# EasyEDA Pro project STM32G303的双FOC电机驱动.eprj, schematic axdr_v1.3, sheets 1 to 2 of 4

## Sheets
1 mcu: Board Name: 1.axdr_v1.3; Create Date: 2025-06-19; Page Name: mcu; Project Name: STM32G303的双FOC电机驱动; Schematic Name: axdr_v1.3; Update Date: 2025-07-27; Company: 嘉立创EDA
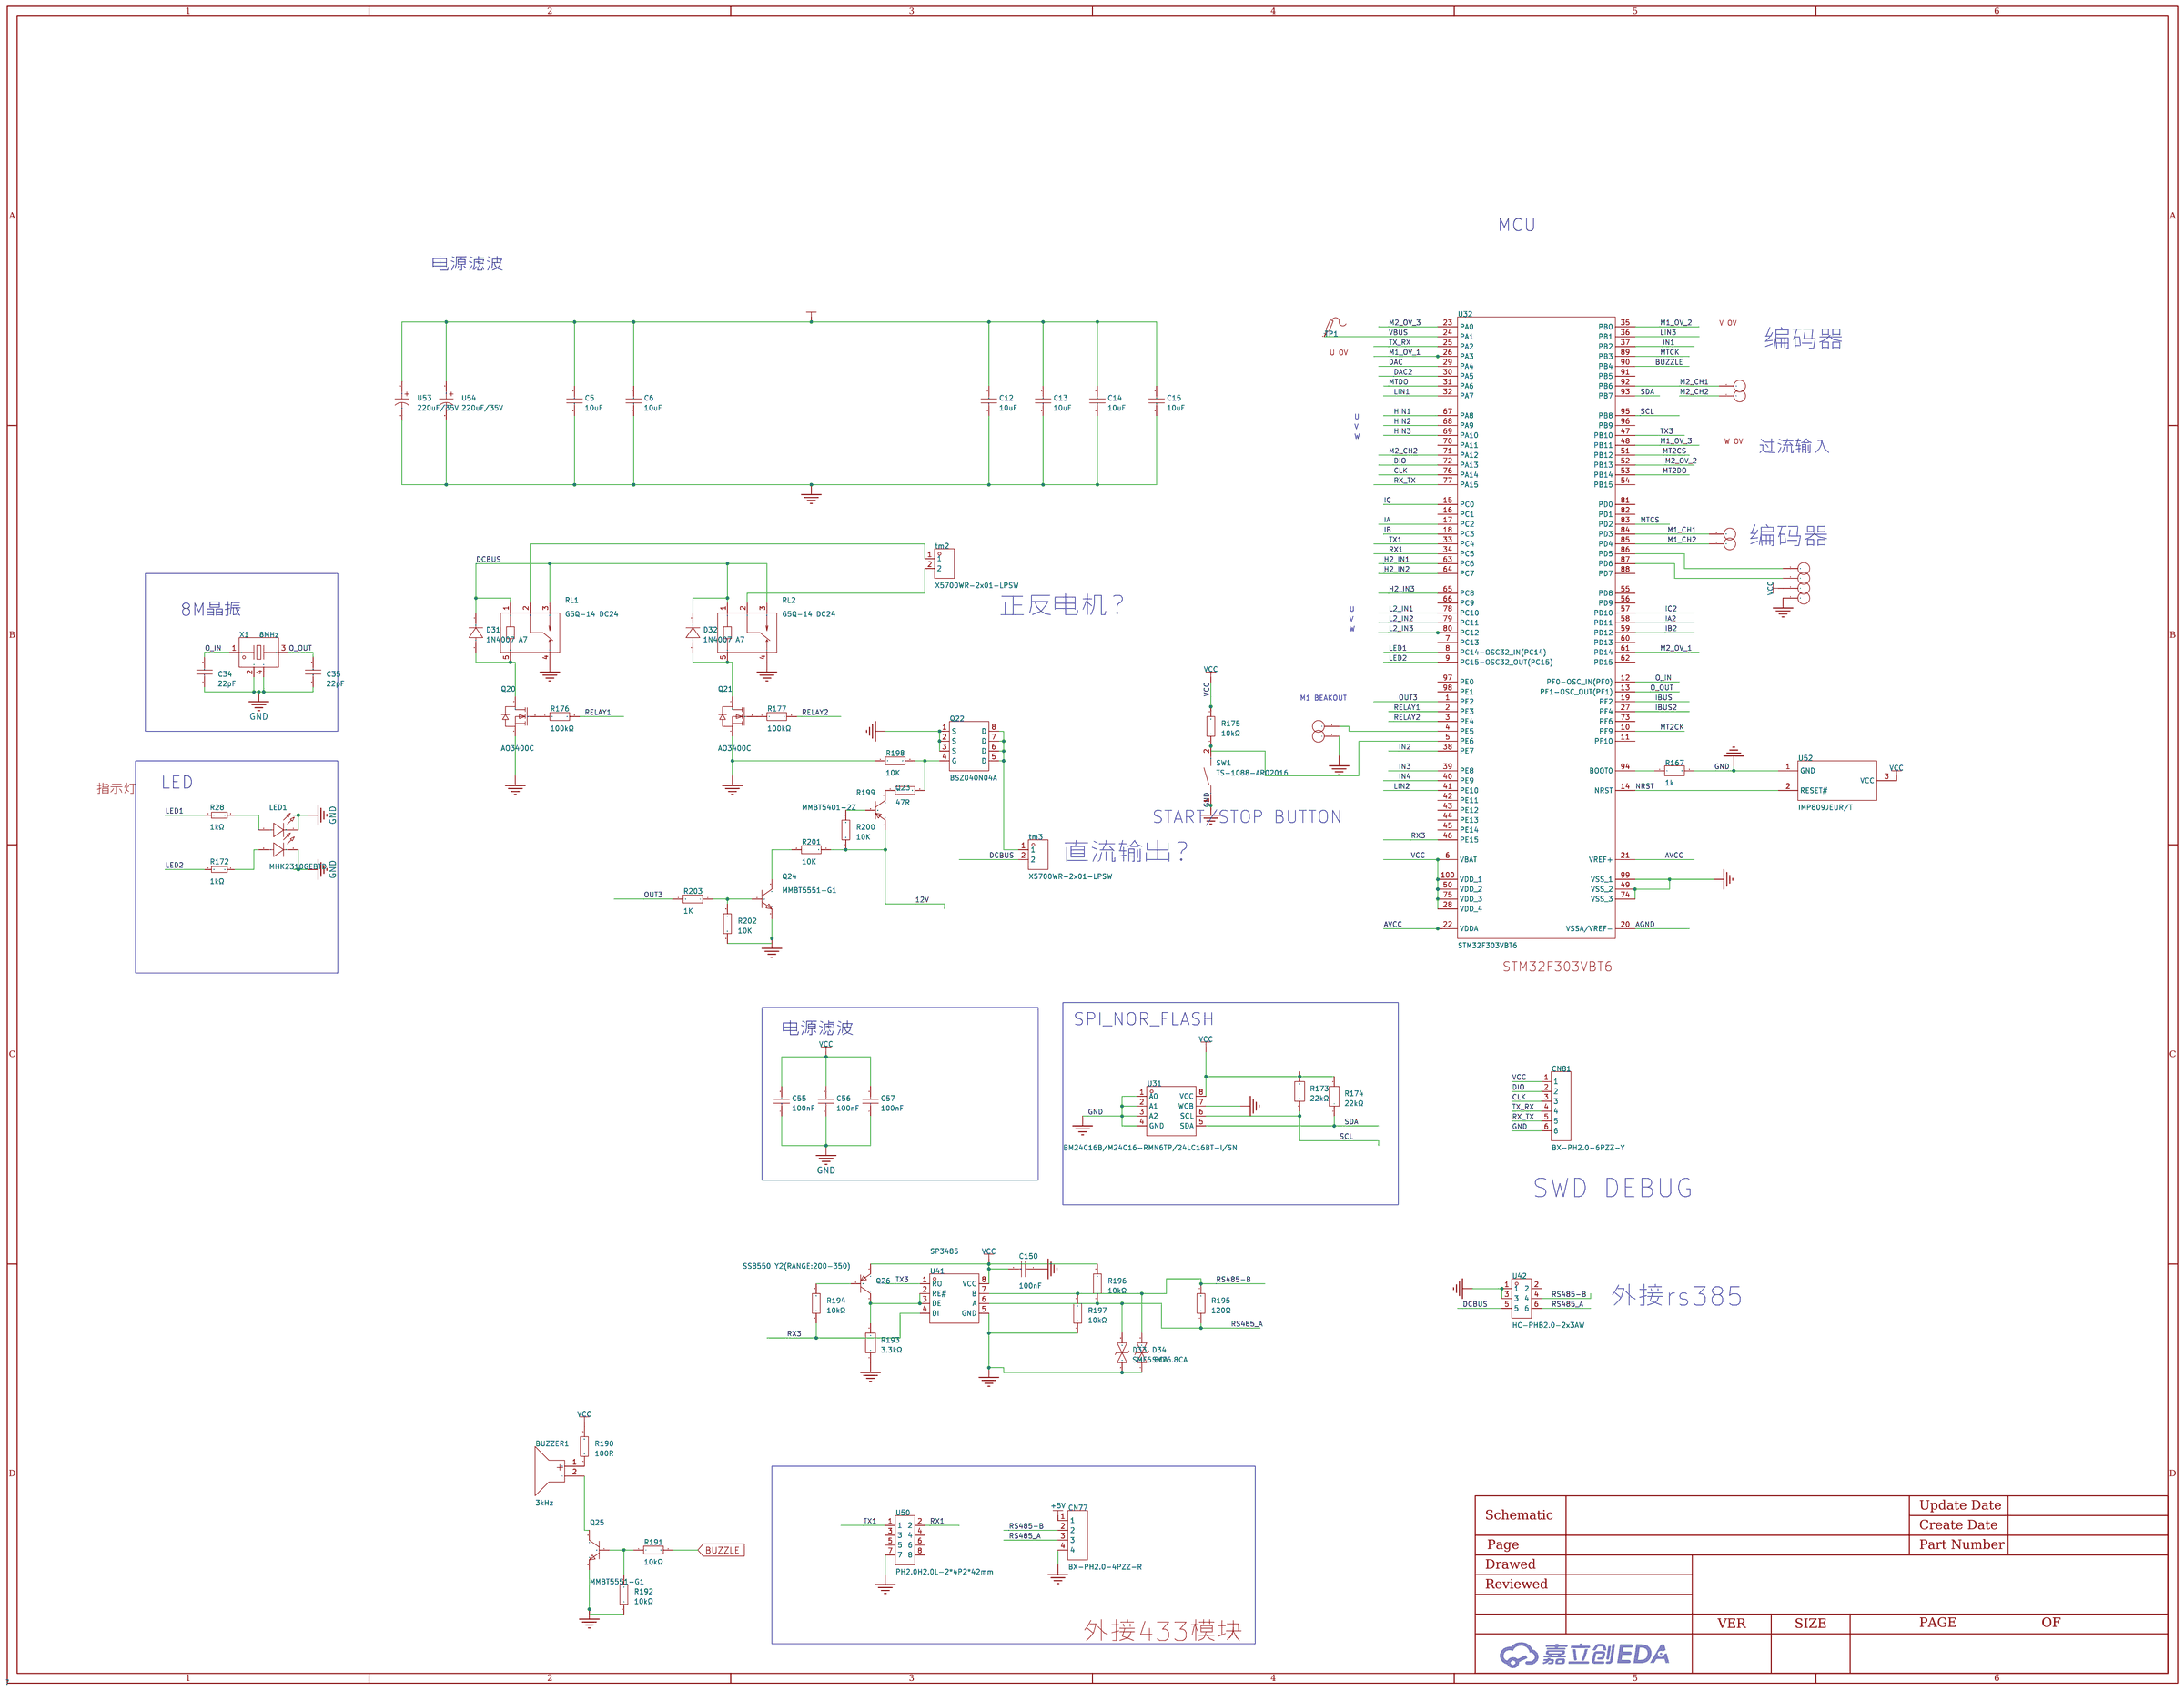
[diagram p1: mcu]
2 电机驱动: Page Name: 电机驱动; Update Date: 2025-07-23; Page Size: A4; Version: V1.0
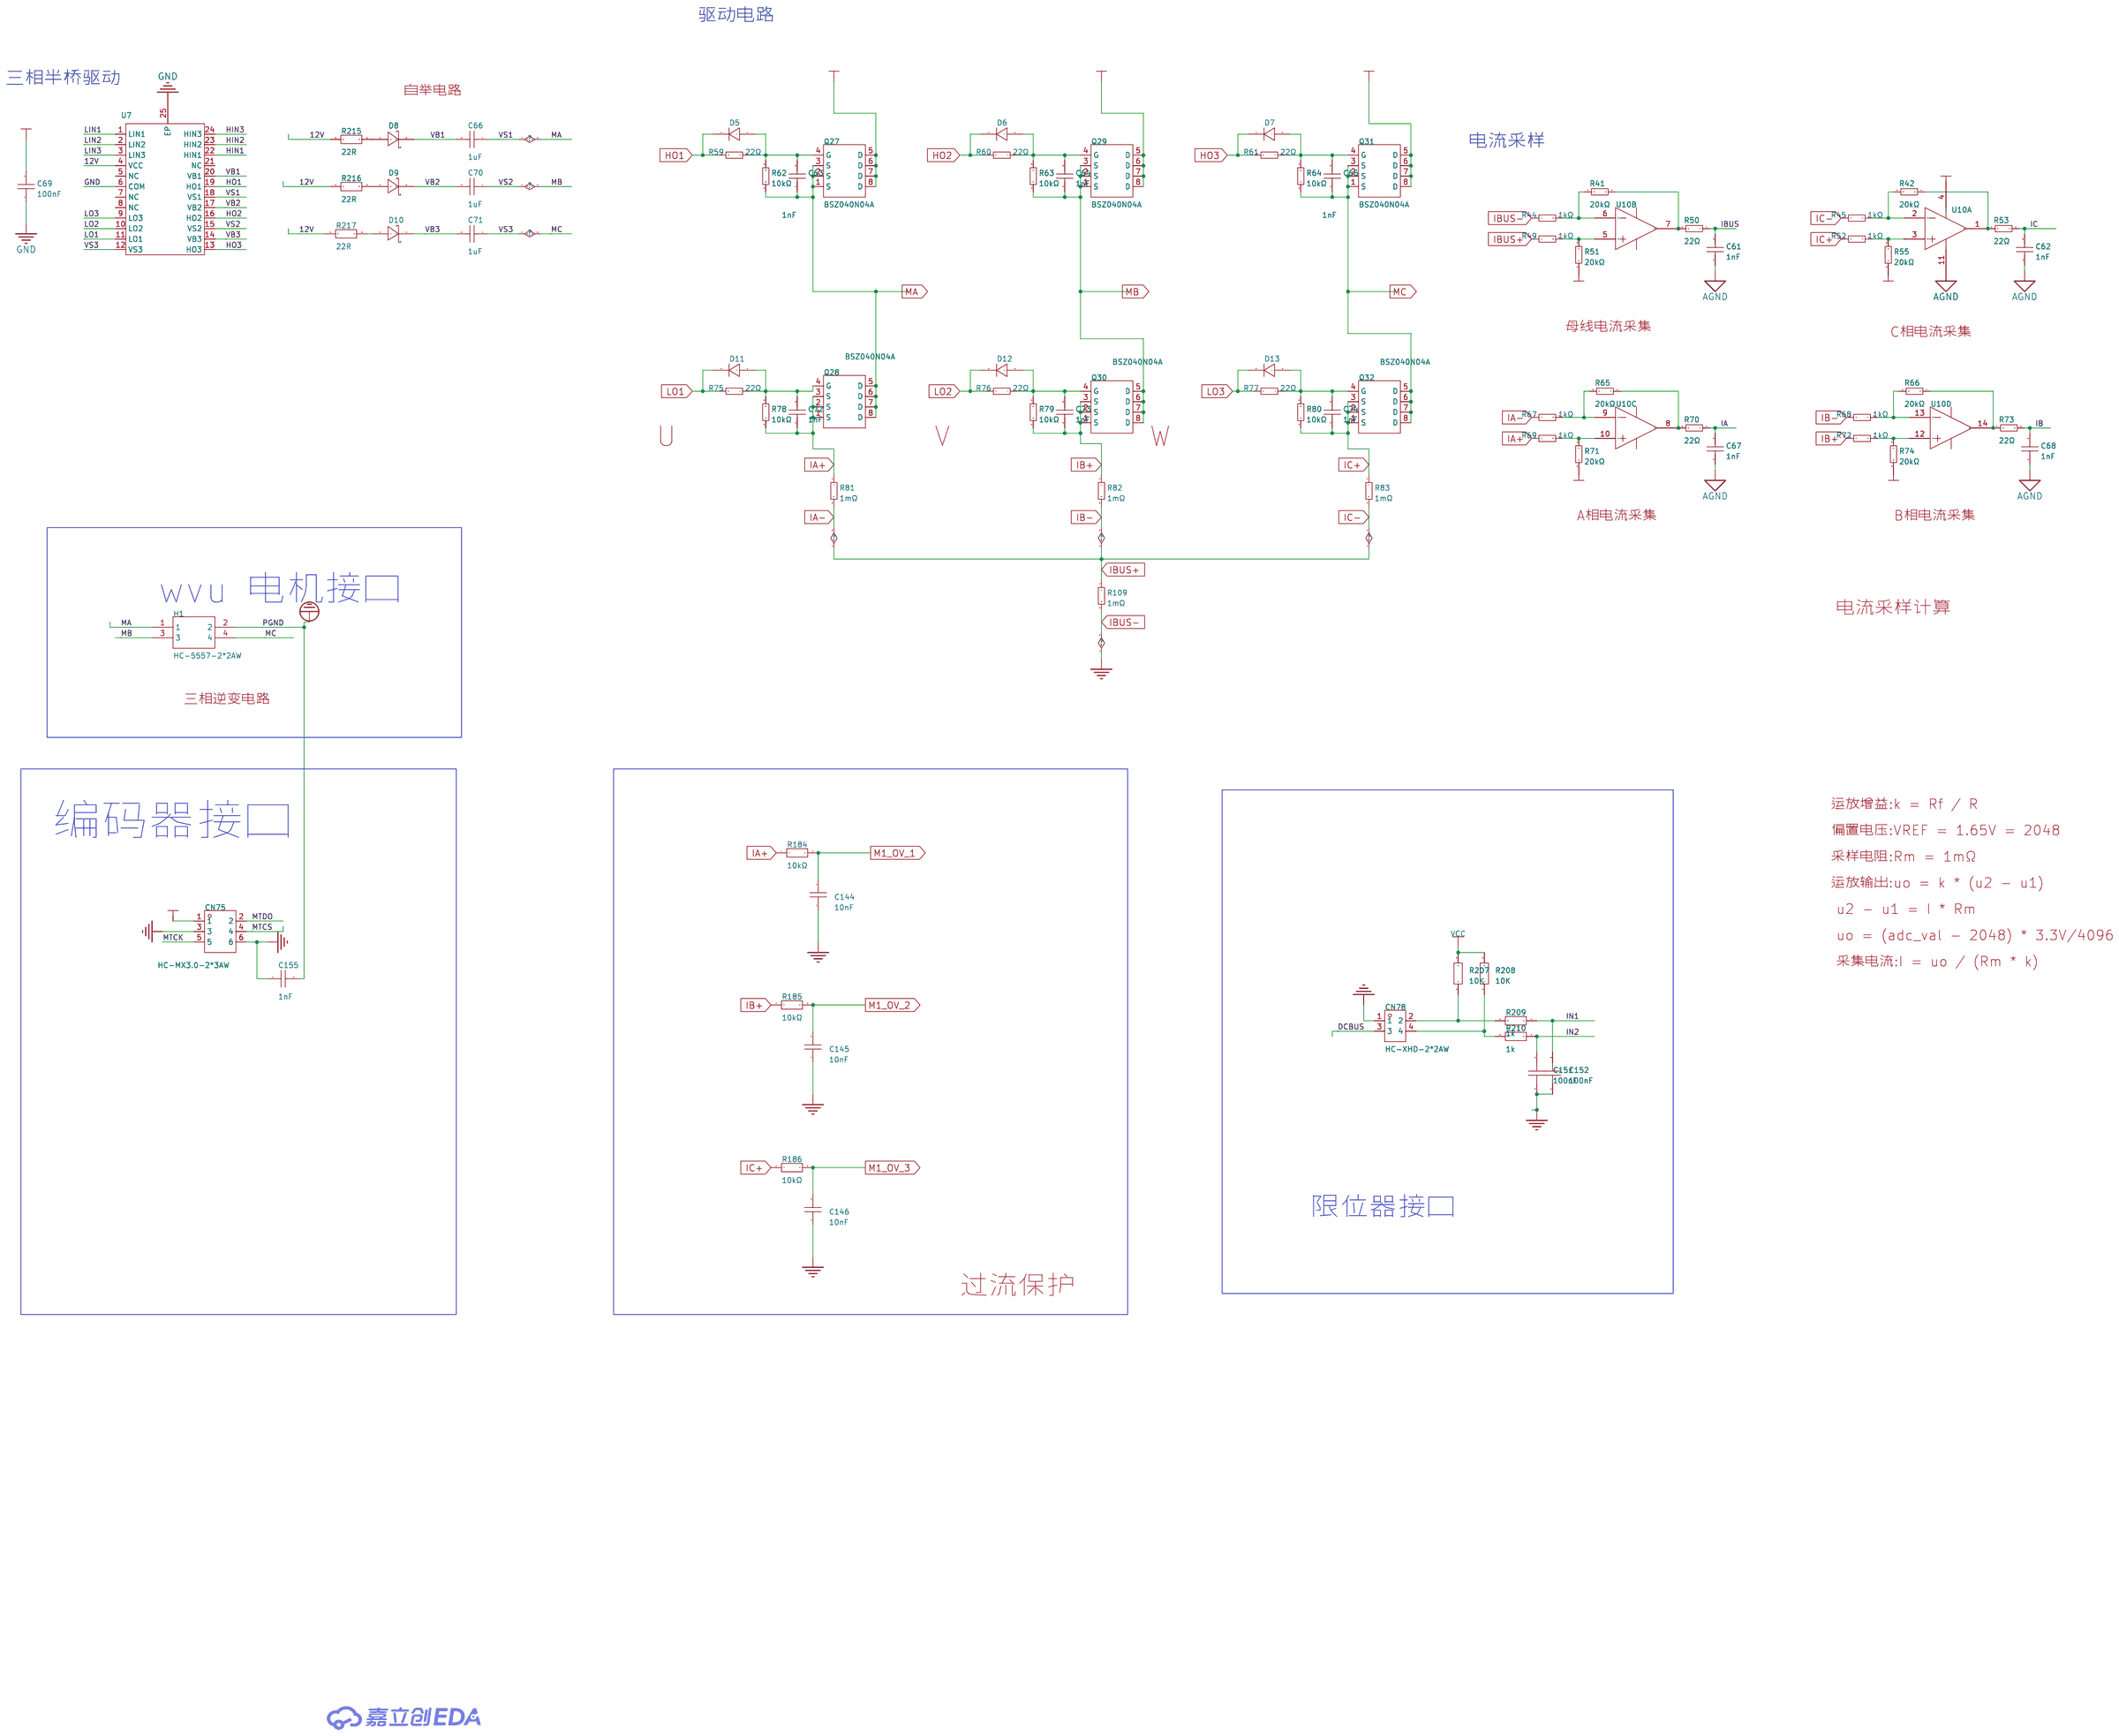
[diagram p2: 电机驱动]

## Parts
sheet mcu
BUZZER1  3kHz  [BUZ-TH_BD9.0-P5.00-D0.6-FD]
C5  10uF  [C1206_S]
C6  10uF  [C1206_S]
C12  10uF  [C1206_S]
C13  10uF  [C1206_S]
C14  10uF  [C1206_S]
C15  10uF  [C1206_S]
C34  22pF  [C0603_S]
C35  22pF  [C0603_S]
C55  100nF  [C0603_S]
C56  100nF  [C0603_S]
C57  100nF  [C0603_S]
C150  100nF  [C0603_S]
CN77  BX-PH2.0-4PZZ-R  [CONN-TH_BX-PH2.0-4PZZ-R]
CN81  BX-PH2.0-6PZZ-Y  [CONN-TH_6P-P2.00_BX-PH2.0-6PZZ-Y]
CN82  5012  [TESTPOINT-TH_BD2.0_C9900010656]  (no BOM)
CN83  5012  [TESTPOINT-TH_BD2.0_C9900010656]  (no BOM)
CN84  5012  [TESTPOINT-TH_BD2.0_C9900010656]  (no BOM)
CN85  5012  [TESTPOINT-TH_BD2.0_C9900010656]  (no BOM)
CN86  5012  [TESTPOINT-TH_BD2.0_C9900010656]  (no BOM)
CN87  5012  [TESTPOINT-TH_BD2.0_C9900010656]  (no BOM)
CN88  5012  [TESTPOINT-TH_BD2.0_C9900010656]  (no BOM)
CN89  5012  [TESTPOINT-TH_BD2.0_C9900010656]  (no BOM)
CN90  5012  [TESTPOINT-TH_BD2.0_C9900010656]  (no BOM)
CN91  5012  [TESTPOINT-TH_BD2.0_C9900010656]  (no BOM)
D31  1N4007 A7  [SOD-123FL_L2.8-W1.8-LS3.7-RD]
D32  1N4007 A7  [SOD-123FL_L2.8-W1.8-LS3.7-RD]
D33  SMF6.8CA  [SOD-123FL_L2.8-W1.8-LS3.7-BI]
D34  SMF6.8CA  [SOD-123FL_L2.8-W1.8-LS3.7-BI]
LED1  MHK2310GEBTD  [LED-TH_4P-L12.8-W4.4_C9900044135]
Q20  AO3400C  [SOT-23-3_L2.9-W1.3-P1.90-LS2.4-BR]
Q21  AO3400C  [SOT-23-3_L2.9-W1.3-P1.90-LS2.4-BR]
Q22  BSZ040N04A  [POWERPAK-1212-8_L3.1-W3.1-P0.65-LS3.3-BL]
Q23  MMBT5401-2Z  [SOT-23-3_L2.9-W1.4-P1.90-LS2.4-TR]
Q24  MMBT5551-G1  [SOT-23-3_L2.9-W1.3-P1.90-LS2.4-BR]
Q25  MMBT5551-G1  [SOT-23-3_L2.9-W1.3-P1.90-LS2.4-BR]
Q26  SS8550 Y2(RANGE:200-350)  [SOT-23-3_L2.9-W1.3-P1.90-LS2.4-BR]
R28  1kΩ  [R0603_S]
R167  1k  [R0603]
R172  1kΩ  [R0603_S]
R173  22kΩ  [R0603]
R174  22kΩ  [R0603]
R175  10kΩ  [R0603]
R176  100kΩ  [R0603]
R177  100kΩ  [R0603]
R190  100R  [R0603]
R191  10kΩ  [R0603]
R192  10kΩ  [R0603]
R193  3.3kΩ  [R0603]
R194  10kΩ  [R0603]
R195  120Ω  [R0603]
R196  10kΩ  [R0603]
R197  10kΩ  [R0603]
R198  10K  [R0603]
R199  47R  [R0603]
R200  10K  [R0603]
R201  10K  [R0603]
R202  10K  [R0603]
R203  1K  [R0603]
RL1  G5Q-14 DC24  [RELAY-TH_G5Q-14-DCXX]
RL2  G5Q-14 DC24  [RELAY-TH_G5Q-14-DCXX]
SW1  TS-1088-AR02016  [SW-SMD_L3.9-W3.0-P4.45]
tm2  X5700WR-2x01-LPSW  [CONN-TH_2P-P5.70_XKB_X5700WR-2X01-LPSW]
tm3  X5700WR-2x01-LPSW  [CONN-TH_2P-P5.70_XKB_X5700WR-2X01-LPSW]
TP1  -  [Test-Point-0.5mm]
U31  BM24C16B/M24C16-RMN6TP/24LC16BT-I/SN  [SOIC-8_L4.9-W3.9-P1.27-LS6.0-BL]
U32  STM32F303VBT6  [LQFP-100_L14.0-W14.0-P0.50-LS16.0-BL]
U41  SP3485  [SOP-8_L4.9-W3.9-P1.27-LS6.0-BL]
U42  HC-PHB2.0-2x3AW  [CONN-TH_6P-P2.00_HC-PHB2.0-2X3AW]
U50  PH2.0H2.0L-2*4P2*42mm  [HDR-TH_8P-P2.00-V-M-R2-C4-S2.00]
U52  IMP809JEUR/T  [SOT-23-3_L2.9-W1.3-P1.90-LS2.4-BR]
U53  220uF/35V  [CAP-TH_BD8.0-P3.50-D0.6-FD_1]
U54  220uF/35V  [CAP-TH_BD8.0-P3.50-D0.6-FD_1]
X1  8MHz  [CRYSTAL-SMD_4P-L3.2-W2.5-BL]
sheet 电机驱动
C61  1nF  [C0603_S]
C62  1nF  [C0603_S]
C63  1nF  [C0603_S]
C64  1nF  [C0603_S]
C65  1nF  [C0603_S]
C66  1uF  [C0603_S]
C67  1nF  [C0603_S]
C68  1nF  [C0603_S]
C69  100nF  [C0603_S]
C70  1uF  [C0603_S]
C71  1uF  [C0603_S]
C72  1nF  [C0603_S]
C73  1nF  [C0603_S]
C74  1nF  [C0603_S]
C144  10nF  [C0603]
C145  10nF  [C0603]
C146  10nF  [C0603]
C151  100nF  [C0603]
C152  100nF  [C0603]
C155  1nF  [C1206]
CN75  HC-MX3.0-2*3AW  [CONN-TH_6P-P3.00_HC-MX3.0-2X3AW_1]
CN78  HC-XHD-2*2AW  [CONN-TH_4P-P2.50_HCTL_HC-XHD-2X2AW]
D5  B16WS  [SOD-323_L1.8-W1.3-LS2.5-RD]
D6  B16WS  [SOD-323_L1.8-W1.3-LS2.5-RD]
D7  B16WS  [SOD-323_L1.8-W1.3-LS2.5-RD]
D8  B16WS  [SOD-323_L1.8-W1.3-LS2.5-RD]
D9  B16WS  [SOD-323_L1.8-W1.3-LS2.5-RD]
D10  B16WS  [SOD-323_L1.8-W1.3-LS2.5-RD]
D11  B16WS  [SOD-323_L1.8-W1.3-LS2.5-RD]
D12  B16WS  [SOD-323_L1.8-W1.3-LS2.5-RD]
D13  B16WS  [SOD-323_L1.8-W1.3-LS2.5-RD]
H1  HC-5557-2*2AW  [CONN-TH_4P-P4.20_5557-2X2AW]
Q27  BSZ040N04A  [POWERPAK-1212-8_L3.1-W3.1-P0.65-LS3.3-BL]
Q28  BSZ040N04A  [POWERPAK-1212-8_L3.1-W3.1-P0.65-LS3.3-BL]
Q29  BSZ040N04A  [POWERPAK-1212-8_L3.1-W3.1-P0.65-LS3.3-BL]
Q30  BSZ040N04A  [POWERPAK-1212-8_L3.1-W3.1-P0.65-LS3.3-BL]
Q31  BSZ040N04A  [POWERPAK-1212-8_L3.1-W3.1-P0.65-LS3.3-BL]
Q32  BSZ040N04A  [POWERPAK-1212-8_L3.1-W3.1-P0.65-LS3.3-BL]
R41  20kΩ  [R0603_S]
R42  20kΩ  [R0603_S]
R44  1kΩ  [R0603_S]
R45  1kΩ  [R0603_S]
R49  1kΩ  [R0603_S]
R50  22Ω  [R0603_S]
R51  20kΩ  [R0603_S]
R52  1kΩ  [R0603_S]
R53  22Ω  [R0603_S]
R55  20kΩ  [R0603_S]
R59  22Ω  [R0603_S]
R60  22Ω  [R0603_S]
R61  22Ω  [R0603_S]
R62  10kΩ  [R0603_S]
R63  10kΩ  [R0603_S]
R64  10kΩ  [R0603_S]
R65  20kΩ  [R0603_S]
R66  20kΩ  [R0603_S]
R67  1kΩ  [R0603_S]
R68  1kΩ  [R0603_S]
R69  1kΩ  [R0603_S]
R70  22Ω  [R0603_S]
R71  20kΩ  [R0603_S]
R72  1kΩ  [R0603_S]
R73  22Ω  [R0603_S]
R74  20kΩ  [R0603_S]
R75  22Ω  [R0603_S]
R76  22Ω  [R0603_S]
R77  22Ω  [R0603_S]
R78  10kΩ  [R0603_S]
R79  10kΩ  [R0603_S]
R80  10kΩ  [R0603_S]
R81  1mΩ  [R2512_S]
R82  1mΩ  [R2512_S]
R83  1mΩ  [R2512_S]
R109  1mΩ  [R2512_S]
R184  10kΩ  [R0603]
R185  10kΩ  [R0603]
R186  10kΩ  [R0603]
R207  10K  [R0603]
R208  10K  [R0603]
R209  1k  [R0603]
R210  1k  [R0603]
R215  22R  [R0603]
R216  22R  [R0603]
R217  22R  [R0603]
U7  FD6288Q  [QFN-24_L4.0-W4.0-P0.50-BL-EP2.6]
U10  RS624XQ  [TSSOP-14_L5.0-W4.4-P0.65-LS6.4-BL]  (sections 1,2,3,4)

## Library data of the parts
BUZZER1 = HNB09A03: 驱动方式:有源(内含驱动线路);构造类型:电磁式;频率:3kHz;声压(SPL):85dB;; LCSC Part Name: 电磁式有源一体蜂鸣器HNB09A03; Supplier Part: C96102; Manufacturer: 华能; Supplier Footprint: 插件,D=9mm; JLCPCB Part Class: 扩展库; Datasheet: https://atta.szlcsc.com/upload/public/pdf/source/20241128/61C4C8C3938BB25F7C38FBE94CCE8DCF.pdf; Supplier: LCSC; Driver Circuitry: 有源(内含驱动线路); Technology: 电磁式; Voltage - Supply: 1.5V~4.5V; Current Consumption: 30mA; Sound Pressure Level(SPL): 85dB; Diameter(φD): 9mm; Height: 5.5mm; Operating Temperature: -20℃~+70℃
C5 C6 C12-C15 = CL31A106KBHNNNE: 容值:10uF;精度:±10%;额定电压:50V;材质(温度系数):X5R;; LCSC Part Name: 10uF ±10% 50V; Supplier Part: C13585; Manufacturer: SAMSUNG(三星); Supplier Footprint: 1206; JLCPCB Part Class: Basic Part; Datasheet: https://atta.szlcsc.com/upload/public/pdf/source/20160218/1457707763339.pdf; Supplier: LCSC; Tolerance: ±10%; Voltage Rated: 50V; Temperature Coefficient: X5R; Pin Type: IN; 值: 10UF; Check: true
C34 C35 = 0603CG220J500NT: 容值:22pF;精度:±5%;额定电压:50V;材质(温度系数):C0G;; LCSC Part Name: 22pF ±5% 50V; Supplier Part: C91701; Manufacturer: FH(风华); Supplier Footprint: 0603; JLCPCB Part Class: Extended Part; Datasheet: https://atta.szlcsc.com/upload/public/pdf/source/20200305/C486355_26A10D38EF8C2A5C37091D0039909270.pdf; Supplier: LCSC; Tolerance: ±5%; Voltage Rated: 50V; Temperature Coefficient: C0G; Pin Type: IN; Check: true
C55-C57 C69 C150 = 0603B104K500NT: 容值:100nF;精度:±10%;额定电压:50V;材质(温度系数):X7R;; LCSC Part Name: 100nF ±10% 50V; Supplier Part: C30926; Manufacturer: FH(风华); Supplier Footprint: 0603; JLCPCB Part Class: Extended Part; Datasheet: https://atta.szlcsc.com/upload/public/pdf/source/20200305/C486355_26A10D38EF8C2A5C37091D0039909270.pdf; Supplier: LCSC; Tolerance: ±10%; Voltage Rated: 50V; Temperature Coefficient: X7R; Pin Type: IN; Check: true
CN77 = BX-PH2.0-4PZZ-R: 插针结构:1x4P;间距:2mm;安装方式:直插;参考系列:PH;总PIN数:4P;排数:1;每排PIN数:4;行距:-;额定电流:2A;触头材质:铜合金;触头镀层:锡;工作温度:-25℃~+85℃;; LCSC Part Name: 1x4P 间距:2mm 直插 系列:PH; Supplier Part: C22388460; Manufacturer: Bossie(博锡); Supplier Footprint: 插件,P=2mm; JLCPCB Part Class: 扩展库; Datasheet: https://atta.szlcsc.com/upload/public/pdf/source/20240429/DDF5CC784B71C7CDA3A8363E9C9D5A43.pdf; Supplier: LCSC; Pins Structure: 1x4P; Pitch: 2mm; Mounting Type: 直插; Reference Series: PH; Number of Pins: 4P; Number of Rows: 1; Number of PINs Per Row: 4; Current Rating: 2A; Contact Material: 铜合金; Contact Plating: 锡; Operating Temperature: -25℃~+85℃; Voltage Rating: 250V; Plastic Material: PA66; Flame Retardant Rating: UL94V-0; Color: 红色; Z-Height of the Board: 6mm; X-Length of Bottom Edge on Board (Spacing Line): 10mm; Y-Width of Bottom Edge on Board: 4.75mm
CN81 = BX-PH2.0-6PZZ-Y: 插针结构:1x6P;间距:2mm;安装方式:直插;参考系列:PH;总PIN数:6P;排数:1;每排PIN数:6;行距:-;额定电流:2A;触头材质:铜合金;触头镀层:锡;工作温度:-25℃~+85℃;; LCSC Part Name: 1x6P 间距:2mm 直插 系列:PH; Supplier Part: C22388472; Manufacturer: Bossie(博锡); Supplier Footprint: 插件,P=2mm; JLCPCB Part Class: 扩展库; Datasheet: https://atta.szlcsc.com/upload/public/pdf/source/20240429/5E4772A627E26FD601F071CDD094C72A.pdf; Supplier: LCSC; Pins Structure: 1x6P; Pitch: 2mm; Mounting Type: 直插; Reference Series: PH; Number of Pins: 6P; Number of Rows: 1; Number of PINs Per Row: 6; Current Rating: 2A; Contact Material: 铜合金; Contact Plating: 锡; Operating Temperature: -25℃~+85℃; Voltage Rating: 200V; Plastic Material: PA66; Color: 黄色; Z-Height of the Board: 6.05mm; X-Length of Bottom Edge on Board (Spacing Line): 14mm; Y-Width of Bottom Edge on Board: 4.7mm
CN82-CN91 = 5012: LCSC Part Name: 测试点; Supplier Part: C2906766; Manufacturer: Keystone; JLCPCB Part Class: ExtendedPart; Datasheet: https://atta.szlcsc.com/upload/public/pdf/source/20211102/12102DF701EA335825673F0350517149.pdf; Supplier: LCSC; Check: true
D31 D32 = 1N4007 A7: 二极管配置:-;正向压降(Vf):1V@1A;直流反向耐压(Vr):1kV;整流电流:1A;; LCSC Part Name: 电压:1kV 电流:1A; Supplier Part: C2902912; Manufacturer: MSKSEMI(美森科); Supplier Footprint: SOD-123FL; JLCPCB Part Class: 扩展库; Datasheet: https://atta.szlcsc.com/upload/public/pdf/source/20240508/1829C9D8507EFBB572682FFAB90585C9.pdf; Supplier: LCSC; Forward Voltage (Vf@If): 1V@1A; Reverse Voltage (Vr): 1kV; Rectified Current: 1A; Reverse Leakage Current: 10uA@1kV
D33 D34 = SMF6.8CA: TVS瞬态抑制二极管; Supplier Part: C48935654; Manufacturer: KUU; Supplier Footprint: SOD-123FL; JLCPCB Part Class: 扩展库; Datasheet: https://atta.szlcsc.com/upload/public/pdf/source/20250514/8718DD7C2B1F63120921CAD898D79D2C.pdf; Supplier: LCSC
LED1 = MHK2310GEBTD: 发光颜色:红色,绿色;正向电压(VF):1.8V~2.4V;正向电流:20mA;主波长:570nm；630nm;透镜颜色:-;发光强度:150mcd；25mcd;发光角度:100°;工作温度:-40℃~+85℃;; LCSC Part Name: 2310直插双灯1.黄绿2.红色光; Supplier Part: C7470875; Manufacturer: MEIHUA(美华); Supplier Footprint: 插件,P=2.54mm; JLCPCB Part Class: 扩展库; Datasheet: https://atta.szlcsc.com/upload/public/pdf/source/20231114/6067A6AFA56FE86899DE59A88A802E23.pdf; Supplier: LCSC; Emitted Color: 红色,绿色; Forward Voltage (VF): 1.8V~2.4V; Forward Current: 20mA; Dominant Wavelength: 570nm；630nm; Luminous Intensity: 150mcd；25mcd; Viewing Angle: 100°; Operating Temperature: -40℃~+85℃
Q20 Q21 = AO3400C: 类型:1个N沟道;漏源电压(Vdss):30V;连续漏极电流(Id):6.2A;导通电阻(RDS(on)):20mΩ@4.5V,5.5A;耗散功率(Pd):-;阈值电压(Vgs(th)):1.3V;; LCSC Part Name: 1个N沟道 耐压:30V 电流:6.2A; Supplier Part: C541722; Manufacturer: AOS; Supplier Footprint: SOT-23; JLCPCB Part Class: 扩展库; Datasheet: https://atta.szlcsc.com/upload/public/pdf/source/20200908/C541722_AFBFDB26E86D8C1A63F798809401D99A.pdf; Supplier: LCSC; Type: 1个N沟道; Drain to Source Voltage: 30V; Current - Continuous Drain(Id): 6.2A; RDS(on): 20mΩ@4.5V,5.5A; Gate Threshold Voltage (Vgs(th)@Id): 1.3V; Gate Charge(Qg): 12nC@10V; Input Capacitance(Ciss@Vds): 600pF@15V; Reverse Transfer Capacitance (Crss@Vds): 60pF@15V; Operating Temperature: -55℃~+150℃
Q22 Q27-Q32 = BSZ040N04A: 类型:1个N沟道;漏源电压(Vdss):40V;连续漏极电流(Id):47A;导通电阻(RDS(on)):5.3mΩ@10V,20A;耗散功率(Pd):29W;阈值电压(Vgs(th)):2.5V;; LCSC Part Name: 场效应管(MOSFET) BSZ040N04A; Supplier Part: C41379059; Manufacturer: KTP(科泰普); Supplier Footprint: PDFN-8L(3x3); Datasheet: https://atta.szlcsc.com/upload/public/pdf/source/20240914/2854D306B8FA293BB1052D2AE5D30D43.pdf; Supplier: LCSC; Type: 1个N沟道; Drain to Source Voltage: 40V; Current - Continuous Drain(Id): 47A; RDS(on): 5.3mΩ@10V,20A; Pd - Power Dissipation: 29W; Gate Threshold Voltage (Vgs(th)@Id): 2.5V; Gate Charge(Qg): 23nC@10V; Input Capacitance(Ciss@Vds): 1.106nF@20V; Reverse Transfer Capacitance (Crss@Vds): 30pF@20V; Operating Temperature: -55℃~+150℃